# Altium schematic sheet fpga.SchDoc (part 1 of 3) (continued)
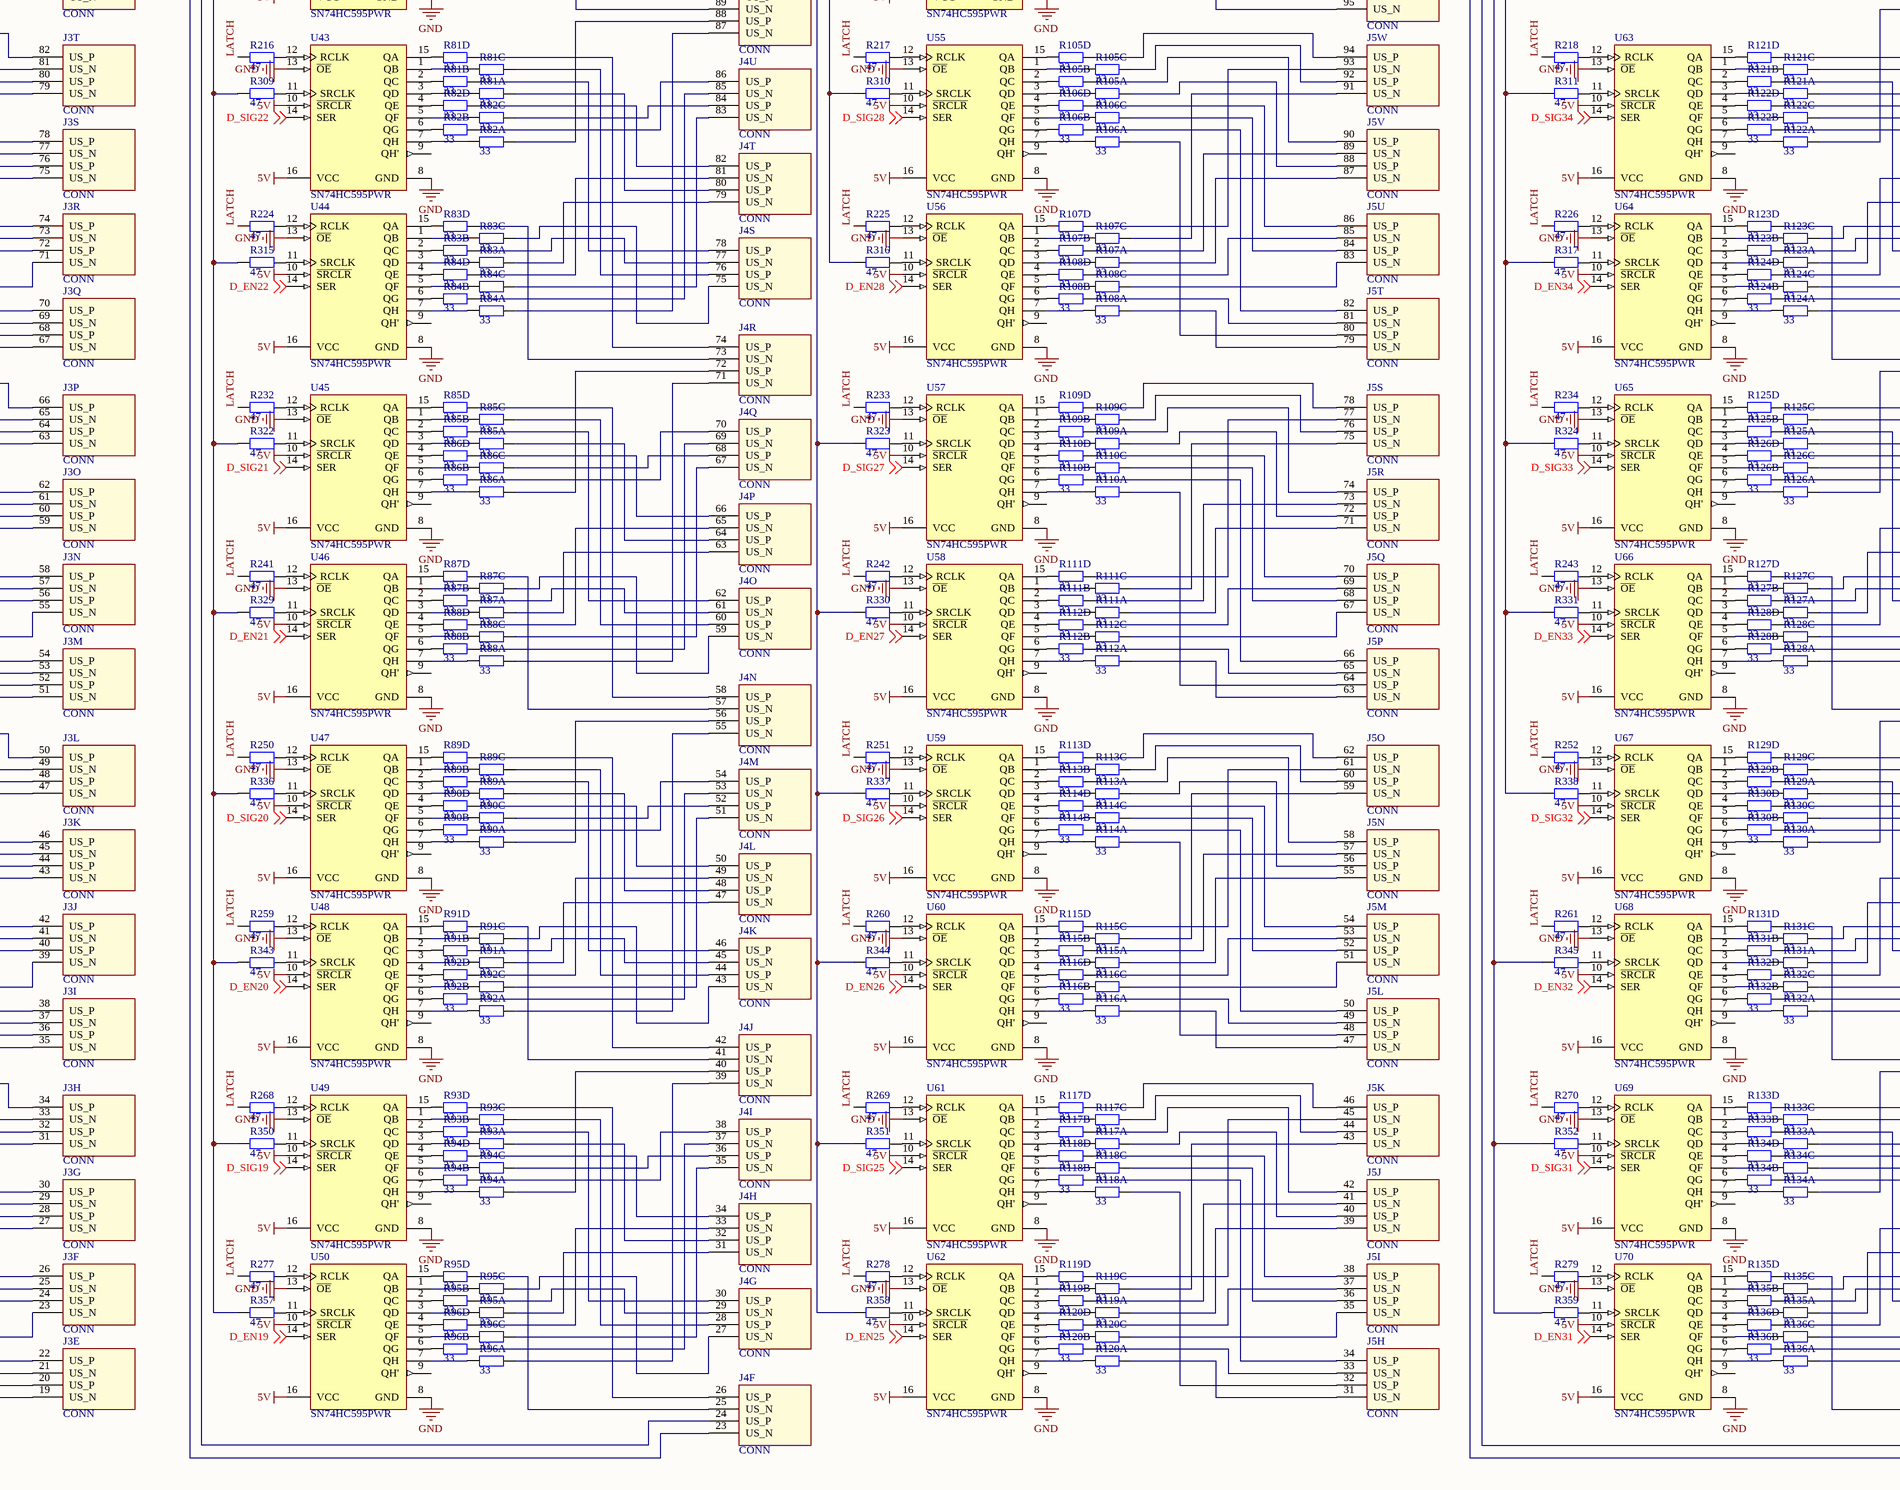
[diagram p4: fpga.SchDoc, bottom middle]
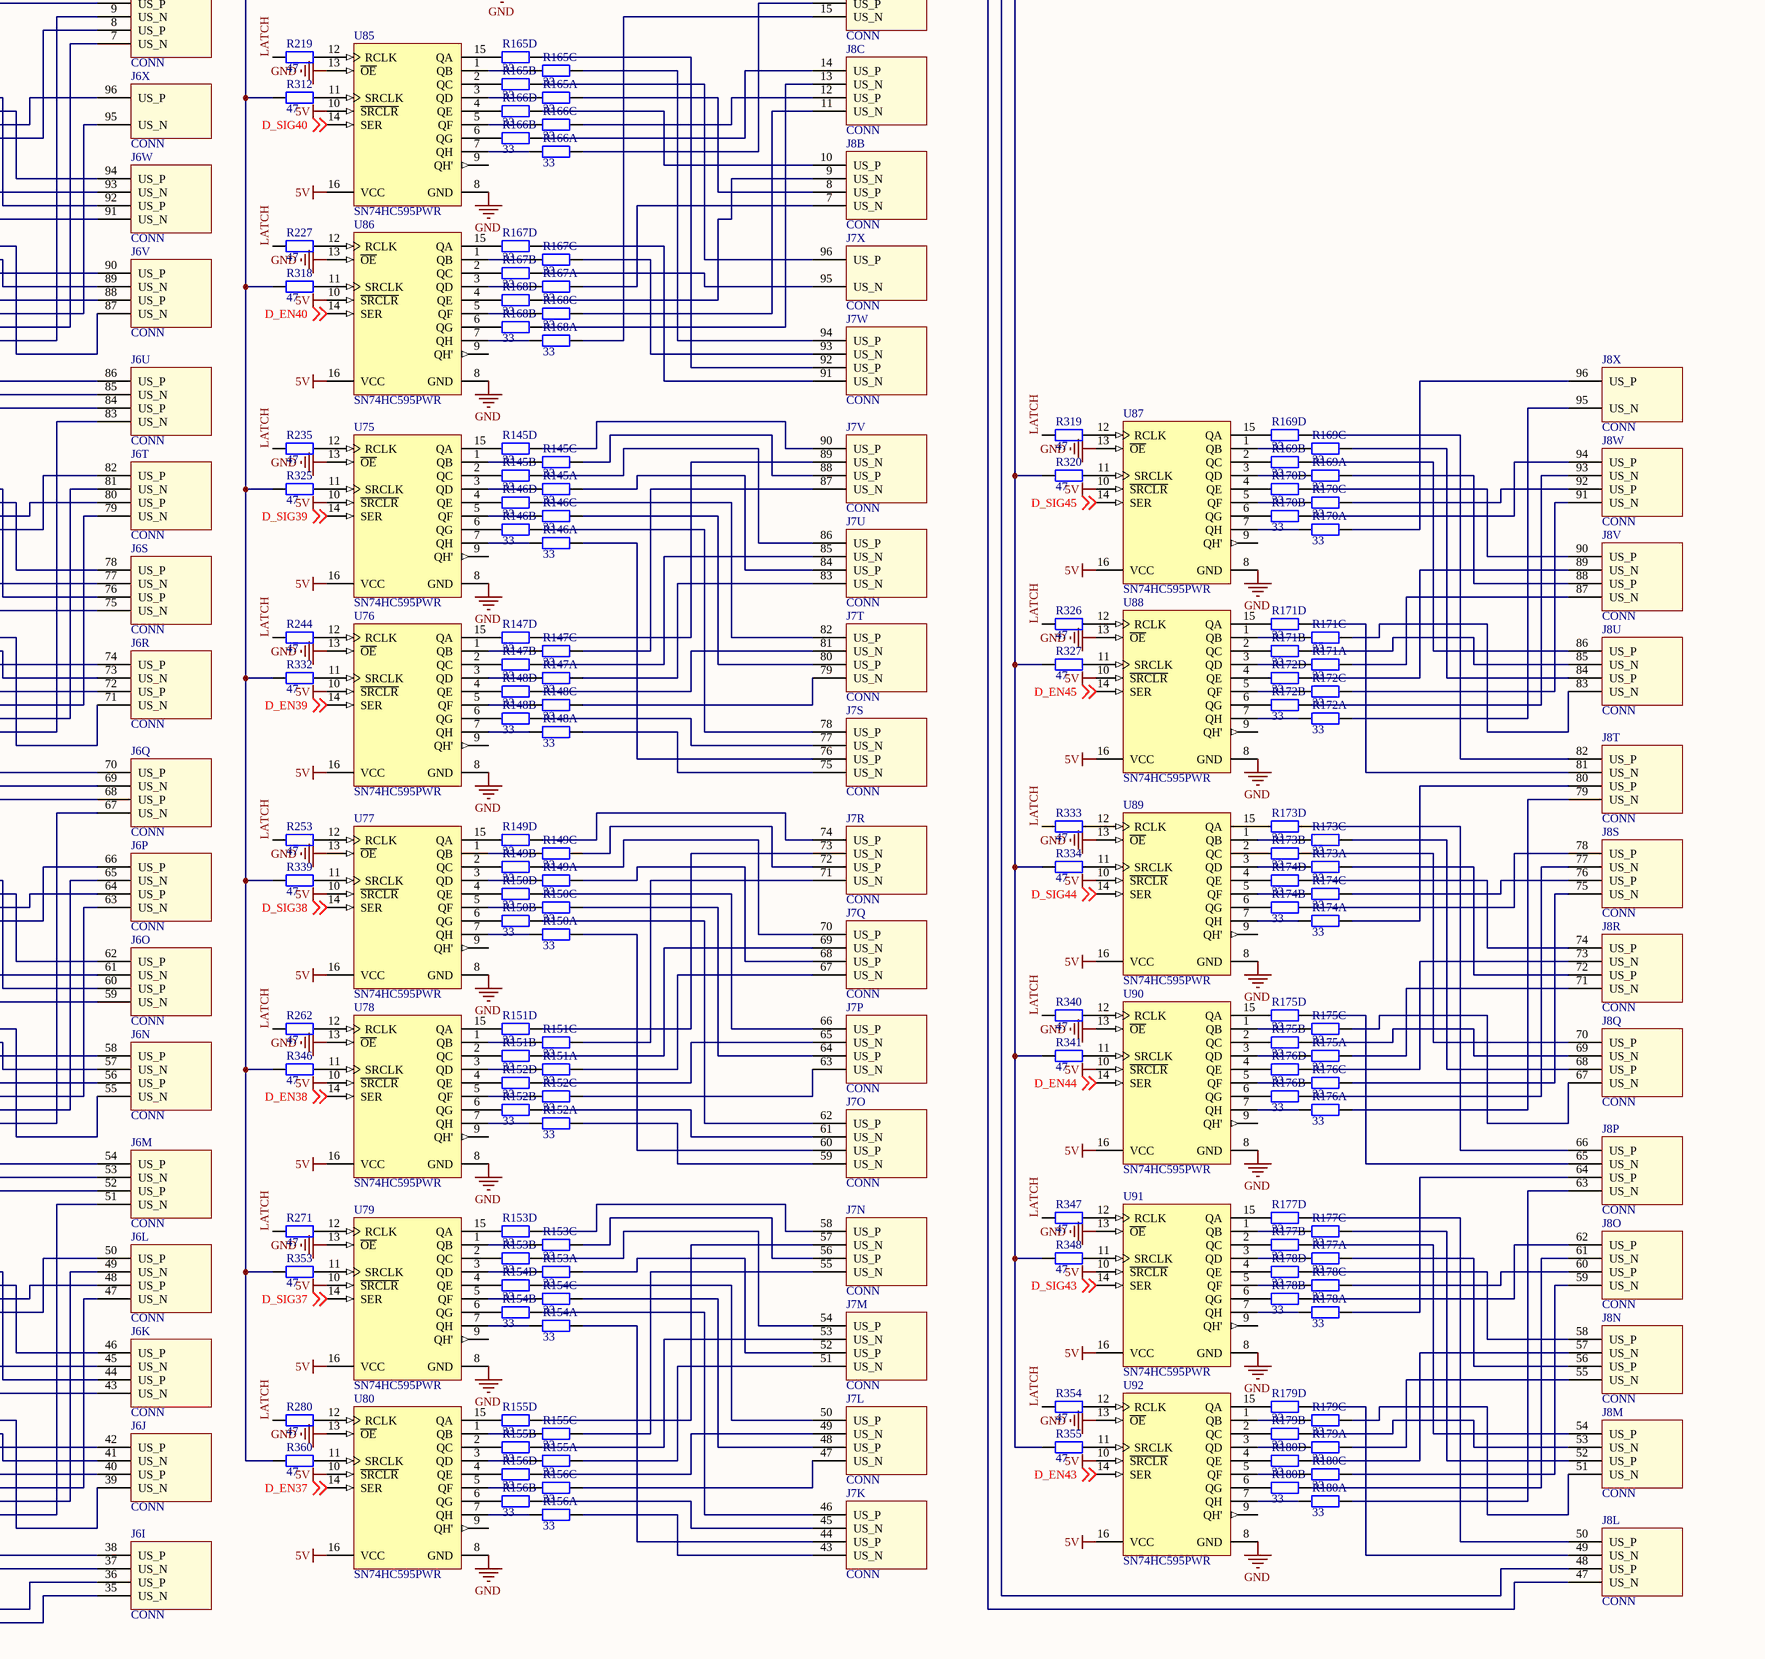
[diagram p5: fpga.SchDoc, bottom right]

## Parts
C1  100n 50V  [C-0603-M]
C2  100n 50V  [C-0603-M]
C3  100n 50V  [C-0603-M]
C4  100n 50V  [C-0603-M]
C5  100n 50V  [C-0603-M]
C6  100n 50V  [C-0603-M]
C7  100n 50V  [C-0603-M]
C8  100n 50V  [C-0603-M]
C9  100n 50V  [C-0603-M]
C10  100n 50V  [C-0603-M]
C11  100n 50V  [C-0603-M]
C12  100n 50V  [C-0603-M]
C13  100n 50V  [C-0603-M]
C14  100n 50V  [C-0603-M]
C15  100n 50V  [C-0603-M]
C16  100n 50V  [C-0603-M]
C17  100n 50V  [C-0603-M]
C18  100n 50V  [C-0603-M]
C19  100n 50V  [C-0603-M]
C20  100n 50V  [C-0603-M]
C21  100n 50V  [C-0603-M]
C22  100n 50V  [C-0603-M]
C23  100n 50V  [C-0603-M]
C24  100n 50V  [C-0603-M]
C25  100n 50V  [C-0603-M]
C26  100n 50V  [C-0603-M]
C27  100n 50V  [C-0603-M]
C28  100n 50V  [C-0603-M]
C29  100n 50V  [C-0603-M]
C30  100n 50V  [C-0603-M]
C31  100n 50V  [C-0603-M]
C32  100n 50V  [C-0603-M]
C33  100n 50V  [C-0603-M]
C34  100n 50V  [C-0603-M]
C35  100n 50V  [C-0603-M]
C36  100n 50V  [C-0603-M]
C37  100n 50V  [C-0603-M]
C38  100n 50V  [C-0603-M]
C39  100n 50V  [C-0603-M]
C40  100n 50V  [C-0603-M]
C41  100n 50V  [C-0603-M]
C42  100n 50V  [C-0603-M]
C43  100n 50V  [C-0603-M]
C44  100n 50V  [C-0603-M]
C45  100n 50V  [C-0603-M]
C46  100n 50V  [C-0603-M]
C47  100n 50V  [C-0603-M]
C48  100n 50V  [C-0603-M]
C49  100n 50V  [C-0603-M]
C50  100n 50V  [C-0603-M]
C51  100n 50V  [C-0603-M]
C52  100n 50V  [C-0603-M]
C53  100n 50V  [C-0603-M]
C54  100n 50V  [C-0603-M]
C55  100n 50V  [C-0603-M]
C56  100n 50V  [C-0603-M]
C57  100n 50V  [C-0603-M]
C58  100n 50V  [C-0603-M]
C59  100n 50V  [C-0603-M]
C60  100n 50V  [C-0603-M]
C61  100n 50V  [C-0603-M]
C62  100n 50V  [C-0603-M]
C63  100n 50V  [C-0603-M]
C64  100n 50V  [C-0603-M]
C65  100n 50V  [C-0603-M]
C66  100n 50V  [C-0603-M]
C67  100n 50V  [C-0603-M]
C68  100n 50V  [C-0603-M]
C69  100n 50V  [C-0603-M]
C70  100n 50V  [C-0603-M]
C71  100n 50V  [C-0603-M]
C72  100n 50V  [C-0603-M]
C73  100n 50V  [C-0603-M]
C74  100n 50V  [C-0603-M]
C75  100n 50V  [C-0603-M]
C76  100n 50V  [C-0603-M]
C77  100n 50V  [C-0603-M]
C78  100n 50V  [C-0603-M]
C79  100n 50V  [C-0603-M]
C80  100n 50V  [C-0603-M]
C81  100n 50V  [C-0603-M]
C82  100n 50V  [C-0603-M]
C83  100n 50V  [C-0603-M]
C84  100n 50V  [C-0603-M]
C85  100n 50V  [C-0603-M]
C86  100n 50V  [C-0603-M]
C87  100n 50V  [C-0603-M]
C88  100n 50V  [C-0603-M]
C89  100n 50V  [C-0603-M]
C90  100n 50V  [C-0603-M]
C91  10u 35V  [C-0805-M]
C92  10u 35V  [C-0805-M]
C93  10u 35V  [C-0805-M]
C94  10u 35V  [C-0805-M]
C95  10u 35V  [C-0805-M]
C96  10u 35V  [C-0805-M]
C97  10u 35V  [C-0805-M]
C98  10u 35V  [C-0805-M]
J1  CONN  [SOP127P640X300-100L]  (parts A,B,C,D,E,F,G,H,I,J,K,L,M,N,O,P,Q,R,S,T,U,V,W,X of 24)
J2  CONN  [SOP127P640X300-100L]  (parts A,B,C,D,E,F,G,H,I,J,K,L,M,N,O,P,Q,R,S,T,U,V,W,X of 24)
J3  CONN  [SOP127P640X300-100L]  (parts A,B,C,D,E,F,G,H,I,J,K,L,M,N,O,P,Q,R,S,T,U,V,W,X of 24)
J4  CONN  [SOP127P640X300-100L]  (parts A,B,C,D,E,F,G,H,I,J,K,L,M,N,O,P,Q,R,S,T,U,V,W,X of 24)
J5  CONN  [SOP127P640X300-100L]  (parts A,B,C,D,E,F,G,H,I,J,K,L,M,N,O,P,Q,R,S,T,U,V,W,X of 24)
J6  CONN  [SOP127P640X300-100L]  (parts A,B,C,D,E,F,G,H,I,J,K,L,M,N,O,P,Q,R,S,T,U,V,W,X of 24)
J7  CONN  [SOP127P640X300-100L]  (parts A,B,C,D,E,F,G,H,I,J,K,L,M,N,O,P,Q,R,S,T,U,V,W,X of 24)
J8  CONN  [SOP127P640X300-100L]  (parts A,B,C,D,E,F,G,H,I,J,K,L,M,N,O,P,Q,R,S,T,U,V,W,X of 24)
R1  33  [CAC-50P200X100-8N]  (parts A,B,C,D of 4)
R2  33  [CAC-50P200X100-8N]  (parts A,B,C,D of 4)
R3  33  [CAC-50P200X100-8N]  (parts A,B,C,D of 4)
R4  33  [CAC-50P200X100-8N]  (parts A,B,C,D of 4)
R5  33  [CAC-50P200X100-8N]  (parts A,B,C,D of 4)
R6  33  [CAC-50P200X100-8N]  (parts A,B,C,D of 4)
R7  33  [CAC-50P200X100-8N]  (parts A,B,C,D of 4)
R8  33  [CAC-50P200X100-8N]  (parts A,B,C,D of 4)
R9  33  [CAC-50P200X100-8N]  (parts A,B,C,D of 4)
R10  33  [CAC-50P200X100-8N]  (parts A,B,C,D of 4)
R11  33  [CAC-50P200X100-8N]  (parts A,B,C,D of 4)
R12  33  [CAC-50P200X100-8N]  (parts A,B,C,D of 4)
R13  33  [CAC-50P200X100-8N]  (parts A,B,C,D of 4)
R14  33  [CAC-50P200X100-8N]  (parts A,B,C,D of 4)
R15  33  [CAC-50P200X100-8N]  (parts A,B,C,D of 4)
R16  33  [CAC-50P200X100-8N]  (parts A,B,C,D of 4)
R17  33  [CAC-50P200X100-8N]  (parts A,B,C,D of 4)
R18  33  [CAC-50P200X100-8N]  (parts A,B,C,D of 4)
R19  33  [CAC-50P200X100-8N]  (parts A,B,C,D of 4)
R20  33  [CAC-50P200X100-8N]  (parts A,B,C,D of 4)
R21  33  [CAC-50P200X100-8N]  (parts A,B,C,D of 4)
R22  33  [CAC-50P200X100-8N]  (parts A,B,C,D of 4)
R23  33  [CAC-50P200X100-8N]  (parts A,B,C,D of 4)
R24  33  [CAC-50P200X100-8N]  (parts A,B,C,D of 4)
R25  33  [CAC-50P200X100-8N]  (parts A,B,C,D of 4)
R26  33  [CAC-50P200X100-8N]  (parts A,B,C,D of 4)
R27  33  [CAC-50P200X100-8N]  (parts A,B,C,D of 4)
R28  33  [CAC-50P200X100-8N]  (parts A,B,C,D of 4)
R29  33  [CAC-50P200X100-8N]  (parts A,B,C,D of 4)
R30  33  [CAC-50P200X100-8N]  (parts A,B,C,D of 4)
R31  33  [CAC-50P200X100-8N]  (parts A,B,C,D of 4)
R32  33  [CAC-50P200X100-8N]  (parts A,B,C,D of 4)
R33  33  [CAC-50P200X100-8N]  (parts A,B,C,D of 4)
R34  33  [CAC-50P200X100-8N]  (parts A,B,C,D of 4)
R35  33  [CAC-50P200X100-8N]  (parts A,B,C,D of 4)
R36  33  [CAC-50P200X100-8N]  (parts A,B,C,D of 4)
R37  33  [CAC-50P200X100-8N]  (parts A,B,C,D of 4)
R38  33  [CAC-50P200X100-8N]  (parts A,B,C,D of 4)
R39  33  [CAC-50P200X100-8N]  (parts A,B,C,D of 4)
R40  33  [CAC-50P200X100-8N]  (parts A,B,C,D of 4)
R41  33  [CAC-50P200X100-8N]  (parts A,B,C,D of 4)
R42  33  [CAC-50P200X100-8N]  (parts A,B,C,D of 4)
R43  33  [CAC-50P200X100-8N]  (parts A,B,C,D of 4)
R44  33  [CAC-50P200X100-8N]  (parts A,B,C,D of 4)
R45  33  [CAC-50P200X100-8N]  (parts A,B,C,D of 4)
R46  33  [CAC-50P200X100-8N]  (parts A,B,C,D of 4)
R47  33  [CAC-50P200X100-8N]  (parts A,B,C,D of 4)
R48  33  [CAC-50P200X100-8N]  (parts A,B,C,D of 4)
R49  33  [CAC-50P200X100-8N]  (parts A,B,C,D of 4)
R50  33  [CAC-50P200X100-8N]  (parts A,B,C,D of 4)
R51  33  [CAC-50P200X100-8N]  (parts A,B,C,D of 4)
R52  33  [CAC-50P200X100-8N]  (parts A,B,C,D of 4)
R53  33  [CAC-50P200X100-8N]  (parts A,B,C,D of 4)
R54  33  [CAC-50P200X100-8N]  (parts A,B,C,D of 4)
R55  33  [CAC-50P200X100-8N]  (parts A,B,C,D of 4)
R56  33  [CAC-50P200X100-8N]  (parts A,B,C,D of 4)
R57  33  [CAC-50P200X100-8N]  (parts A,B,C,D of 4)
R58  33  [CAC-50P200X100-8N]  (parts A,B,C,D of 4)
R59  33  [CAC-50P200X100-8N]  (parts A,B,C,D of 4)
R60  33  [CAC-50P200X100-8N]  (parts A,B,C,D of 4)
R61  33  [CAC-50P200X100-8N]  (parts A,B,C,D of 4)
R62  33  [CAC-50P200X100-8N]  (parts A,B,C,D of 4)
R63  33  [CAC-50P200X100-8N]  (parts A,B,C,D of 4)
R64  33  [CAC-50P200X100-8N]  (parts A,B,C,D of 4)
R65  33  [CAC-50P200X100-8N]  (parts A,B,C,D of 4)
R66  33  [CAC-50P200X100-8N]  (parts A,B,C,D of 4)
R67  33  [CAC-50P200X100-8N]  (parts A,B,C,D of 4)
R68  33  [CAC-50P200X100-8N]  (parts A,B,C,D of 4)
R69  33  [CAC-50P200X100-8N]  (parts A,B,C,D of 4)
R70  33  [CAC-50P200X100-8N]  (parts A,B,C,D of 4)
R71  33  [CAC-50P200X100-8N]  (parts A,B,C,D of 4)
R72  33  [CAC-50P200X100-8N]  (parts A,B,C,D of 4)
R73  33  [CAC-50P200X100-8N]  (parts A,B,C,D of 4)
R74  33  [CAC-50P200X100-8N]  (parts A,B,C,D of 4)
R75  33  [CAC-50P200X100-8N]  (parts A,B,C,D of 4)
R76  33  [CAC-50P200X100-8N]  (parts A,B,C,D of 4)
R77  33  [CAC-50P200X100-8N]  (parts A,B,C,D of 4)
R78  33  [CAC-50P200X100-8N]  (parts A,B,C,D of 4)
R79  33  [CAC-50P200X100-8N]  (parts A,B,C,D of 4)
R80  33  [CAC-50P200X100-8N]  (parts A,B,C,D of 4)
R81  33  [CAC-50P200X100-8N]  (parts A,B,C,D of 4)
R82  33  [CAC-50P200X100-8N]  (parts A,B,C,D of 4)
R83  33  [CAC-50P200X100-8N]  (parts A,B,C,D of 4)
R84  33  [CAC-50P200X100-8N]  (parts A,B,C,D of 4)
R85  33  [CAC-50P200X100-8N]  (parts A,B,C,D of 4)
R86  33  [CAC-50P200X100-8N]  (parts A,B,C,D of 4)
R87  33  [CAC-50P200X100-8N]  (parts A,B,C,D of 4)
R88  33  [CAC-50P200X100-8N]  (parts A,B,C,D of 4)
R89  33  [CAC-50P200X100-8N]  (parts A,B,C,D of 4)
R90  33  [CAC-50P200X100-8N]  (parts A,B,C,D of 4)
R91  33  [CAC-50P200X100-8N]  (parts A,B,C,D of 4)
R92  33  [CAC-50P200X100-8N]  (parts A,B,C,D of 4)
R93  33  [CAC-50P200X100-8N]  (parts A,B,C,D of 4)
R94  33  [CAC-50P200X100-8N]  (parts A,B,C,D of 4)
R95  33  [CAC-50P200X100-8N]  (parts A,B,C,D of 4)
R96  33  [CAC-50P200X100-8N]  (parts A,B,C,D of 4)
R97  33  [CAC-50P200X100-8N]  (parts A,B,C,D of 4)
R98  33  [CAC-50P200X100-8N]  (parts A,B,C,D of 4)
R99  33  [CAC-50P200X100-8N]  (parts A,B,C,D of 4)
R100  33  [CAC-50P200X100-8N]  (parts A,B,C,D of 4)
R101  33  [CAC-50P200X100-8N]  (parts A,B,C,D of 4)
R102  33  [CAC-50P200X100-8N]  (parts A,B,C,D of 4)
R103  33  [CAC-50P200X100-8N]  (parts A,B,C,D of 4)
R104  33  [CAC-50P200X100-8N]  (parts A,B,C,D of 4)
R105  33  [CAC-50P200X100-8N]  (parts A,B,C,D of 4)
R106  33  [CAC-50P200X100-8N]  (parts A,B,C,D of 4)
R107  33  [CAC-50P200X100-8N]  (parts A,B,C,D of 4)
R108  33  [CAC-50P200X100-8N]  (parts A,B,C,D of 4)
R109  33  [CAC-50P200X100-8N]  (parts A,B,C,D of 4)
R110  33  [CAC-50P200X100-8N]  (parts A,B,C,D of 4)
R111  33  [CAC-50P200X100-8N]  (parts A,B,C,D of 4)
R112  33  [CAC-50P200X100-8N]  (parts A,B,C,D of 4)
R113  33  [CAC-50P200X100-8N]  (parts A,B,C,D of 4)
R114  33  [CAC-50P200X100-8N]  (parts A,B,C,D of 4)
R115  33  [CAC-50P200X100-8N]  (parts A,B,C,D of 4)
R116  33  [CAC-50P200X100-8N]  (parts A,B,C,D of 4)
R117  33  [CAC-50P200X100-8N]  (parts A,B,C,D of 4)
R118  33  [CAC-50P200X100-8N]  (parts A,B,C,D of 4)
R119  33  [CAC-50P200X100-8N]  (parts A,B,C,D of 4)
R120  33  [CAC-50P200X100-8N]  (parts A,B,C,D of 4)
R121  33  [CAC-50P200X100-8N]  (parts A,B,C,D of 4)
R122  33  [CAC-50P200X100-8N]  (parts A,B,C,D of 4)
R123  33  [CAC-50P200X100-8N]  (parts A,B,C,D of 4)
R124  33  [CAC-50P200X100-8N]  (parts A,B,C,D of 4)
R125  33  [CAC-50P200X100-8N]  (parts A,B,C,D of 4)
R126  33  [CAC-50P200X100-8N]  (parts A,B,C,D of 4)
R127  33  [CAC-50P200X100-8N]  (parts A,B,C,D of 4)
R128  33  [CAC-50P200X100-8N]  (parts A,B,C,D of 4)
R129  33  [CAC-50P200X100-8N]  (parts A,B,C,D of 4)
R130  33  [CAC-50P200X100-8N]  (parts A,B,C,D of 4)
R131  33  [CAC-50P200X100-8N]  (parts A,B,C,D of 4)
R132  33  [CAC-50P200X100-8N]  (parts A,B,C,D of 4)
R133  33  [CAC-50P200X100-8N]  (parts A,B,C,D of 4)
R134  33  [CAC-50P200X100-8N]  (parts A,B,C,D of 4)
R135  33  [CAC-50P200X100-8N]  (parts A,B,C,D of 4)
R136  33  [CAC-50P200X100-8N]  (parts A,B,C,D of 4)
R137  33  [CAC-50P200X100-8N]  (parts A,B,C,D of 4)
R138  33  [CAC-50P200X100-8N]  (parts A,B,C,D of 4)
R139  33  [CAC-50P200X100-8N]  (parts A,B,C,D of 4)
R140  33  [CAC-50P200X100-8N]  (parts A,B,C,D of 4)
R141  33  [CAC-50P200X100-8N]  (parts A,B,C,D of 4)
R142  33  [CAC-50P200X100-8N]  (parts A,B,C,D of 4)
R143  33  [CAC-50P200X100-8N]  (parts A,B,C,D of 4)
R144  33  [CAC-50P200X100-8N]  (parts A,B,C,D of 4)
R145  33  [CAC-50P200X100-8N]  (parts A,B,C,D of 4)
R146  33  [CAC-50P200X100-8N]  (parts A,B,C,D of 4)
R147  33  [CAC-50P200X100-8N]  (parts A,B,C,D of 4)
R148  33  [CAC-50P200X100-8N]  (parts A,B,C,D of 4)
R149  33  [CAC-50P200X100-8N]  (parts A,B,C,D of 4)
R150  33  [CAC-50P200X100-8N]  (parts A,B,C,D of 4)
R151  33  [CAC-50P200X100-8N]  (parts A,B,C,D of 4)
R152  33  [CAC-50P200X100-8N]  (parts A,B,C,D of 4)
R153  33  [CAC-50P200X100-8N]  (parts A,B,C,D of 4)
R154  33  [CAC-50P200X100-8N]  (parts A,B,C,D of 4)
R155  33  [CAC-50P200X100-8N]  (parts A,B,C,D of 4)
R156  33  [CAC-50P200X100-8N]  (parts A,B,C,D of 4)
R157  33  [CAC-50P200X100-8N]  (parts A,B,C,D of 4)
R158  33  [CAC-50P200X100-8N]  (parts A,B,C,D of 4)
R159  33  [CAC-50P200X100-8N]  (parts A,B,C,D of 4)
R160  33  [CAC-50P200X100-8N]  (parts A,B,C,D of 4)
R161  33  [CAC-50P200X100-8N]  (parts A,B,C,D of 4)
R162  33  [CAC-50P200X100-8N]  (parts A,B,C,D of 4)
R163  33  [CAC-50P200X100-8N]  (parts A,B,C,D of 4)
R164  33  [CAC-50P200X100-8N]  (parts A,B,C,D of 4)
R165  33  [CAC-50P200X100-8N]  (parts A,B,C,D of 4)
R166  33  [CAC-50P200X100-8N]  (parts A,B,C,D of 4)
R167  33  [CAC-50P200X100-8N]  (parts A,B,C,D of 4)
R168  33  [CAC-50P200X100-8N]  (parts A,B,C,D of 4)
R169  33  [CAC-50P200X100-8N]  (parts A,B,C,D of 4)
R170  33  [CAC-50P200X100-8N]  (parts A,B,C,D of 4)
R171  33  [CAC-50P200X100-8N]  (parts A,B,C,D of 4)
R172  33  [CAC-50P200X100-8N]  (parts A,B,C,D of 4)
R173  33  [CAC-50P200X100-8N]  (parts A,B,C,D of 4)
R174  33  [CAC-50P200X100-8N]  (parts A,B,C,D of 4)
R175  33  [CAC-50P200X100-8N]  (parts A,B,C,D of 4)
R176  33  [CAC-50P200X100-8N]  (parts A,B,C,D of 4)
R177  33  [CAC-50P200X100-8N]  (parts A,B,C,D of 4)
R178  33  [CAC-50P200X100-8N]  (parts A,B,C,D of 4)
R179  33  [CAC-50P200X100-8N]  (parts A,B,C,D of 4)
R180  33  [CAC-50P200X100-8N]  (parts A,B,C,D of 4)
R181  47  [R-0603-H]
R182  47  [R-0603-H]
R183  47  [R-0603-H]
R184  47  [R-0603-H]
R185  47  [R-0603-H]
R186  47  [R-0603-H]
R187  47  [R-0603-H]
R188  47  [R-0603-H]
R189  47  [R-0603-H]
R190  47  [R-0603-H]
R191  47  [R-0603-H]
R192  47  [R-0603-H]
R193  47  [R-0603-H]
R194  47  [R-0603-H]
R195  47  [R-0603-H]
R196  47  [R-0603-H]
R197  47  [R-0603-H]
R198  47  [R-0603-H]
R199  47  [R-0603-H]
R200  47  [R-0603-H]
R201  47  [R-0603-H]
R202  47  [R-0603-H]
R203  47  [R-0603-H]
R204  47  [R-0603-H]
R205  47  [R-0603-H]
R206  47  [R-0603-H]
R207  47  [R-0603-H]
R208  47  [R-0603-H]
R209  47  [R-0603-H]
R210  47  [R-0603-H]
R211  47  [R-0603-H]
R212  47  [R-0603-H]
R213  47  [R-0603-H]
R214  47  [R-0603-H]
R215  47  [R-0603-H]
R216  47  [R-0603-H]
R217  47  [R-0603-H]
R218  47  [R-0603-H]
R219  47  [R-0603-H]
R220  47  [R-0603-H]
R221  47  [R-0603-H]
R222  47  [R-0603-H]
R223  47  [R-0603-H]
R224  47  [R-0603-H]
R225  47  [R-0603-H]
R226  47  [R-0603-H]
R227  47  [R-0603-H]
R228  47  [R-0603-H]
R229  47  [R-0603-H]
R230  47  [R-0603-H]
R231  47  [R-0603-H]
R232  47  [R-0603-H]
R233  47  [R-0603-H]
R234  47  [R-0603-H]
R235  47  [R-0603-H]
R236  47  [R-0603-H]
R237  47  [R-0603-H]
R238  47  [R-0603-H]
R239  47  [R-0603-H]
R240  47  [R-0603-H]
R241  47  [R-0603-H]
R242  47  [R-0603-H]
R243  47  [R-0603-H]
R244  47  [R-0603-H]
R245  47  [R-0603-H]
R246  47  [R-0603-H]
R247  47  [R-0603-H]
R248  47  [R-0603-H]
R249  47  [R-0603-H]
R250  47  [R-0603-H]
R251  47  [R-0603-H]
R252  47  [R-0603-H]
R253  47  [R-0603-H]
R254  47  [R-0603-H]
R255  47  [R-0603-H]
R256  47  [R-0603-H]
R257  47  [R-0603-H]
R258  47  [R-0603-H]
R259  47  [R-0603-H]
R260  47  [R-0603-H]
R261  47  [R-0603-H]
R262  47  [R-0603-H]
R263  47  [R-0603-H]
R264  47  [R-0603-H]
R265  47  [R-0603-H]
R266  47  [R-0603-H]
R267  47  [R-0603-H]
R268  47  [R-0603-H]
R269  47  [R-0603-H]
R270  47  [R-0603-H]
R271  47  [R-0603-H]
R272  47  [R-0603-H]
R273  47  [R-0603-H]
R274  47  [R-0603-H]
R275  47  [R-0603-H]
R276  47  [R-0603-H]
R277  47  [R-0603-H]
R278  47  [R-0603-H]
R279  47  [R-0603-H]
R280  47  [R-0603-H]
R281  47  [R-0603-H]
R282  47  [R-0603-H]
R283  47  [R-0603-H]
R284  47  [R-0603-H]
R285  47  [R-0603-H]
R286  47  [R-0603-H]
R287  47  [R-0603-H]
R288  47  [R-0603-H]
R289  47  [R-0603-H]
R290  47  [R-0603-H]
R291  47  [R-0603-H]
R292  47  [R-0603-H]
R293  47  [R-0603-H]
R294  47  [R-0603-H]
R295  47  [R-0603-H]
R296  47  [R-0603-H]
R297  47  [R-0603-H]
R298  47  [R-0603-H]
R299  47  [R-0603-H]
R300  47  [R-0603-H]
R301  47  [R-0603-H]
R302  47  [R-0603-H]
R303  47  [R-0603-H]
R304  47  [R-0603-H]
R305  47  [R-0603-H]
R306  47  [R-0603-H]
R307  47  [R-0603-H]
R308  47  [R-0603-H]
R309  47  [R-0603-H]
R310  47  [R-0603-H]
R311  47  [R-0603-H]
R312  47  [R-0603-H]
R313  47  [R-0603-H]
R314  47  [R-0603-H]
R315  47  [R-0603-H]
R316  47  [R-0603-H]
R317  47  [R-0603-H]
R318  47  [R-0603-H]
R319  47  [R-0603-H]
R320  47  [R-0603-H]
R321  47  [R-0603-H]
R322  47  [R-0603-H]
R323  47  [R-0603-H]
R324  47  [R-0603-H]
R325  47  [R-0603-H]
R326  47  [R-0603-H]
R327  47  [R-0603-H]
R328  47  [R-0603-H]
R329  47  [R-0603-H]
R330  47  [R-0603-H]
R331  47  [R-0603-H]
R332  47  [R-0603-H]
R333  47  [R-0603-H]
R334  47  [R-0603-H]
R335  47  [R-0603-H]
R336  47  [R-0603-H]
R337  47  [R-0603-H]
R338  47  [R-0603-H]
R339  47  [R-0603-H]
R340  47  [R-0603-H]
R341  47  [R-0603-H]
R342  47  [R-0603-H]
R343  47  [R-0603-H]
R344  47  [R-0603-H]
R345  47  [R-0603-H]
R346  47  [R-0603-H]
R347  47  [R-0603-H]
R348  47  [R-0603-H]
R349  47  [R-0603-H]
R350  47  [R-0603-H]
R351  47  [R-0603-H]
R352  47  [R-0603-H]
R353  47  [R-0603-H]
R354  47  [R-0603-H]
R355  47  [R-0603-H]
R356  47  [R-0603-H]
R357  47  [R-0603-H]
R358  47  [R-0603-H]
R359  47  [R-0603-H]
R360  47  [R-0603-H]
U1  SN74HC595PWR  [PW0016A_L]
U2  SN74HC595PWR  [PW0016A_L]
U3  SN74HC595PWR  [PW0016A_L]
U4  SN74HC595PWR  [PW0016A_L]
U5  SN74HC595PWR  [PW0016A_L]
U6  SN74HC595PWR  [PW0016A_L]
U7  SN74HC595PWR  [PW0016A_L]
U8  SN74HC595PWR  [PW0016A_L]
U9  SN74HC595PWR  [PW0016A_L]
U10  SN74HC595PWR  [PW0016A_L]
U11  SN74HC595PWR  [PW0016A_L]
U12  SN74HC595PWR  [PW0016A_L]
U13  SN74HC595PWR  [PW0016A_L]
U14  SN74HC595PWR  [PW0016A_L]
U15  SN74HC595PWR  [PW0016A_L]
U16  SN74HC595PWR  [PW0016A_L]
U17  SN74HC595PWR  [PW0016A_L]
U18  SN74HC595PWR  [PW0016A_L]
U19  SN74HC595PWR  [PW0016A_L]
U20  SN74HC595PWR  [PW0016A_L]
U21  SN74HC595PWR  [PW0016A_L]
U22  SN74HC595PWR  [PW0016A_L]
U23  SN74HC595PWR  [PW0016A_L]
U24  SN74HC595PWR  [PW0016A_L]
U27  SN74HC595PWR  [PW0016A_L]
U28  SN74HC595PWR  [PW0016A_L]
U29  SN74HC595PWR  [PW0016A_L]
U30  SN74HC595PWR  [PW0016A_L]
U31  SN74HC595PWR  [PW0016A_L]
U32  SN74HC595PWR  [PW0016A_L]
U33  SN74HC595PWR  [PW0016A_L]
U34  SN74HC595PWR  [PW0016A_L]
U35  SN74HC595PWR  [PW0016A_L]
U36  SN74HC595PWR  [PW0016A_L]
U37  SN74HC595PWR  [PW0016A_L]
U38  SN74HC595PWR  [PW0016A_L]
U39  SN74HC595PWR  [PW0016A_L]
U40  SN74HC595PWR  [PW0016A_L]
U41  SN74HC595PWR  [PW0016A_L]
U42  SN74HC595PWR  [PW0016A_L]
U43  SN74HC595PWR  [PW0016A_L]
U44  SN74HC595PWR  [PW0016A_L]
U45  SN74HC595PWR  [PW0016A_L]
U46  SN74HC595PWR  [PW0016A_L]
U47  SN74HC595PWR  [PW0016A_L]
U48  SN74HC595PWR  [PW0016A_L]
U49  SN74HC595PWR  [PW0016A_L]
U50  SN74HC595PWR  [PW0016A_L]
U51  SN74HC595PWR  [PW0016A_L]
U52  SN74HC595PWR  [PW0016A_L]
U53  SN74HC595PWR  [PW0016A_L]
U54  SN74HC595PWR  [PW0016A_L]
U55  SN74HC595PWR  [PW0016A_L]
U56  SN74HC595PWR  [PW0016A_L]
U57  SN74HC595PWR  [PW0016A_L]
U58  SN74HC595PWR  [PW0016A_L]
U59  SN74HC595PWR  [PW0016A_L]
U60  SN74HC595PWR  [PW0016A_L]
U61  SN74HC595PWR  [PW0016A_L]
U62  SN74HC595PWR  [PW0016A_L]
U63  SN74HC595PWR  [PW0016A_L]
U64  SN74HC595PWR  [PW0016A_L]
U65  SN74HC595PWR  [PW0016A_L]
U66  SN74HC595PWR  [PW0016A_L]
U67  SN74HC595PWR  [PW0016A_L]
U68  SN74HC595PWR  [PW0016A_L]
U69  SN74HC595PWR  [PW0016A_L]
U70  SN74HC595PWR  [PW0016A_L]
U71  SN74HC595PWR  [PW0016A_L]
U72  SN74HC595PWR  [PW0016A_L]
U73  SN74HC595PWR  [PW0016A_L]
U74  SN74HC595PWR  [PW0016A_L]
U75  SN74HC595PWR  [PW0016A_L]
U76  SN74HC595PWR  [PW0016A_L]
U77  SN74HC595PWR  [PW0016A_L]
U78  SN74HC595PWR  [PW0016A_L]
U79  SN74HC595PWR  [PW0016A_L]
U80  SN74HC595PWR  [PW0016A_L]
U81  SN74HC595PWR  [PW0016A_L]
U82  SN74HC595PWR  [PW0016A_L]
U83  SN74HC595PWR  [PW0016A_L]
U84  SN74HC595PWR  [PW0016A_L]
U85  SN74HC595PWR  [PW0016A_L]
U86  SN74HC595PWR  [PW0016A_L]
U87  SN74HC595PWR  [PW0016A_L]
U88  SN74HC595PWR  [PW0016A_L]
U89  SN74HC595PWR  [PW0016A_L]
U90  SN74HC595PWR  [PW0016A_L]
U91  SN74HC595PWR  [PW0016A_L]
U92  SN74HC595PWR  [PW0016A_L]